# EasyEDA Pro project 蓝桥杯14届国赛.eprj, board PCB
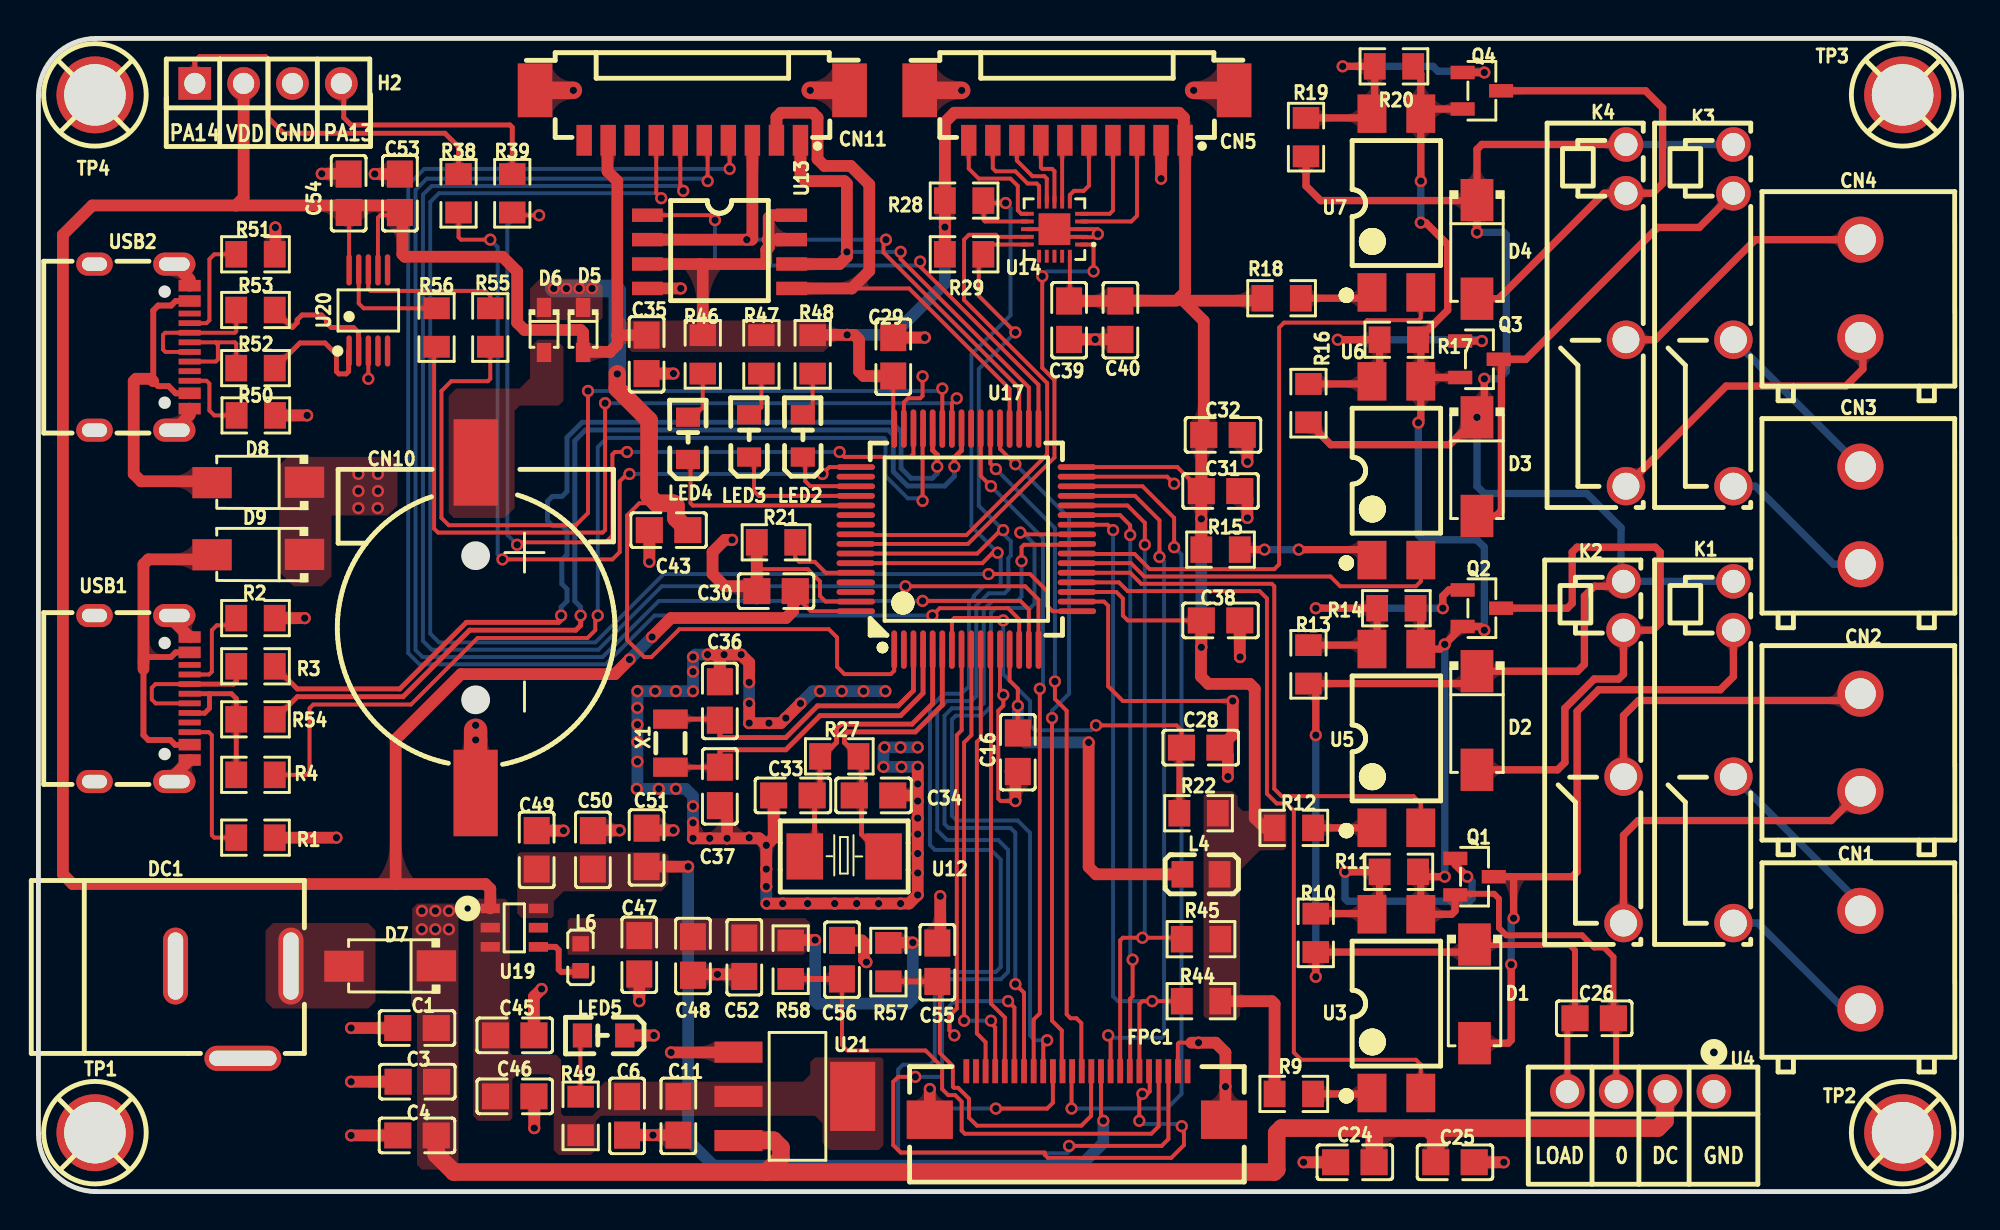
[diagram p3: board, top side]
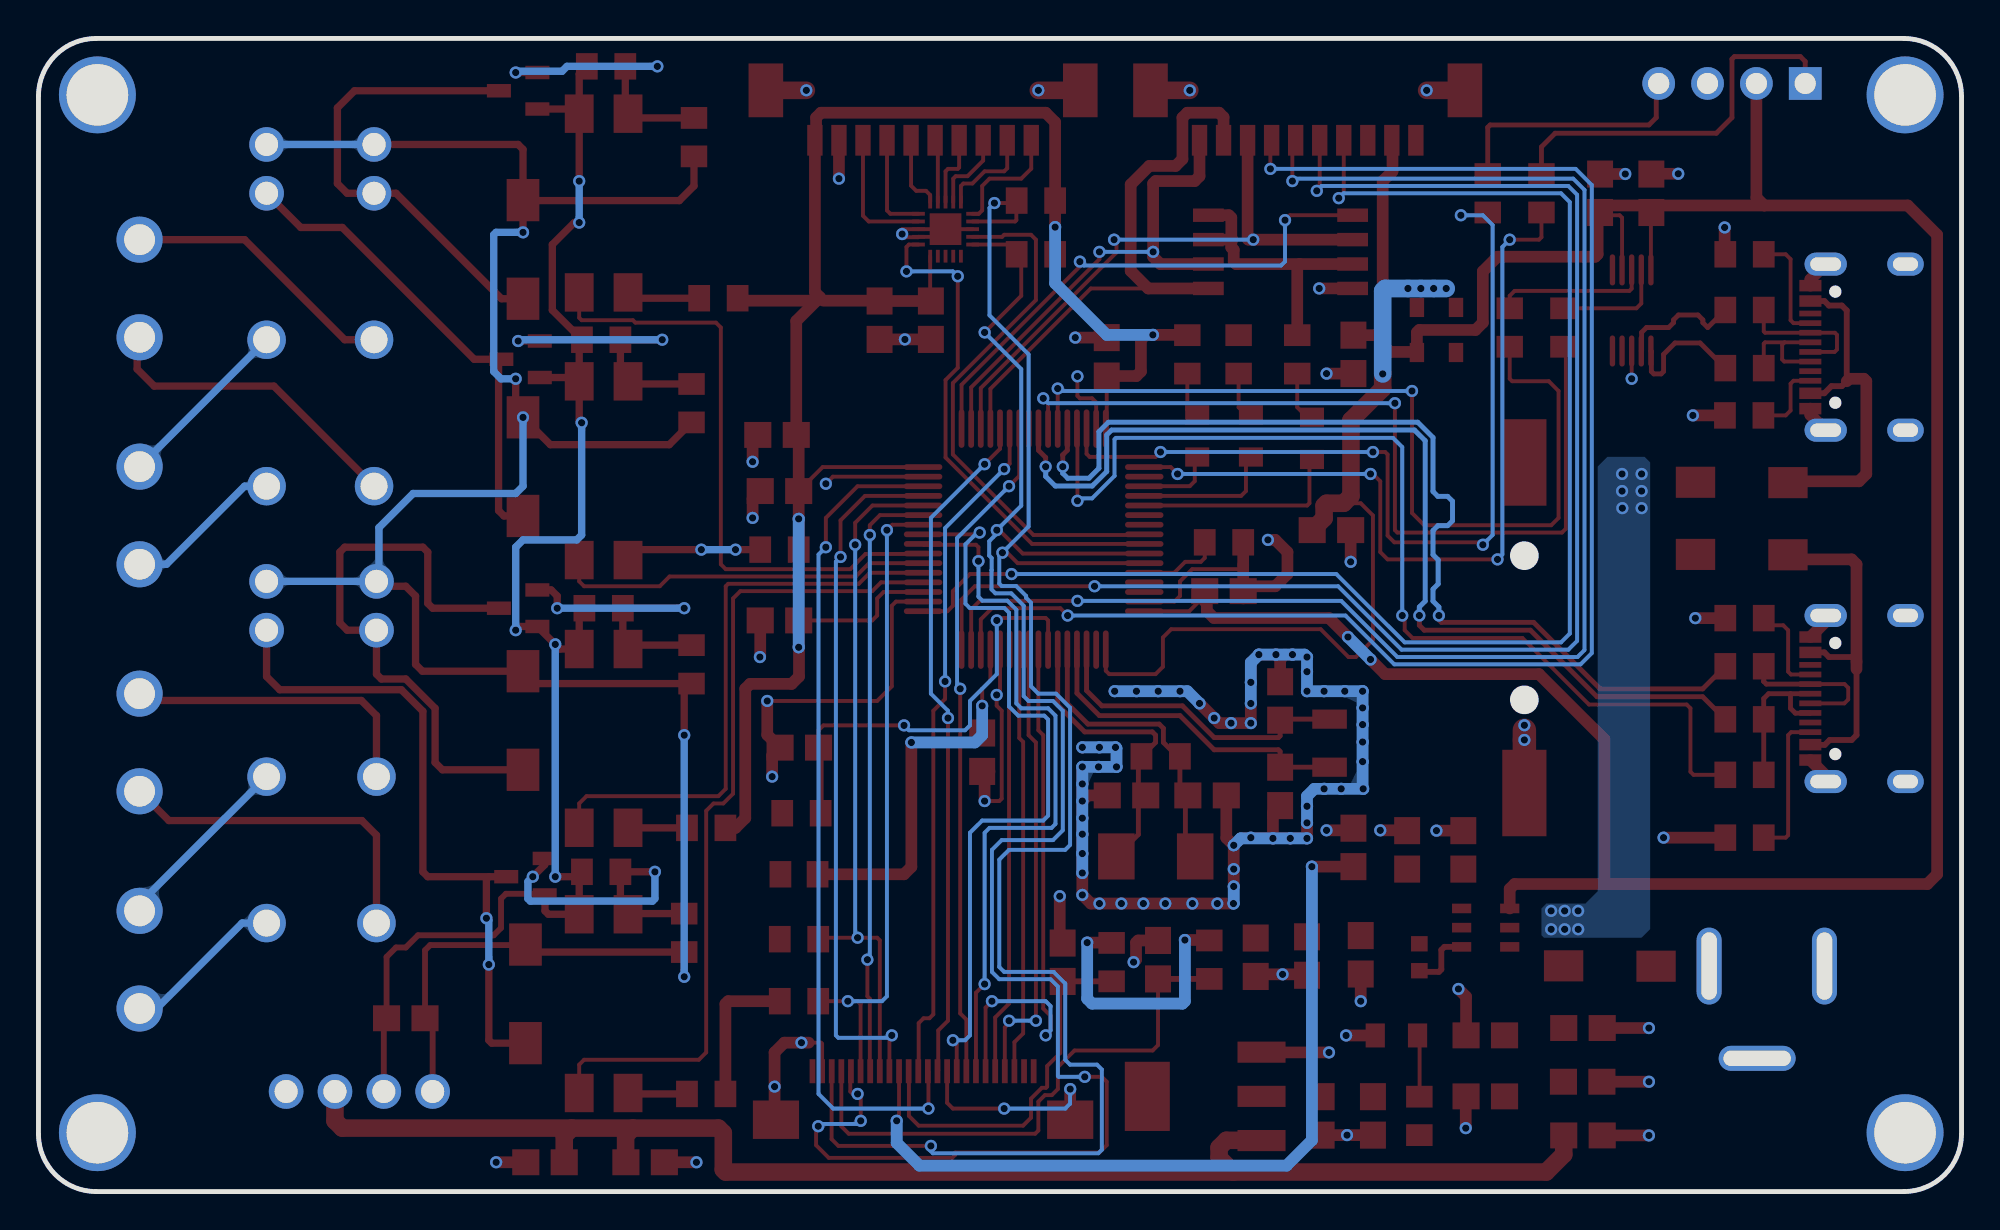
[diagram p4: board, bottom side, seen from below]

Outline 100 x 60 mm; copper layers: Top Layer, Bottom Layer. Coordinates in mm from the lower left corner of the outline.
Outline path: 0,57 arc(0.88,59.12) 3,60 97,60 arc(99.12,59.12) 100,57 100,3 arc(99.12,0.88) 97,0 3,0 arc(0.88,0.88) 0,3 0,57
Stack: Top Layer 0.035mm / Dielectric1 1.51mm FR4 er 4.5 / Bottom Layer 0.035mm

## Design rules (mm)
net USB_DN1: DP6
net $1N986: DP2
net $1N6306: DP2
net USB_DP2: DP3
net USB_DN2: DP3
net USB_CTRL: DP6
net M_HX1: DP5
net M_HX2: DP5
template: 自定义配置
spacing copperThickness1oz (default): track to track 0.178, other pairs 0.152 to 0.203
spacing copperThickness2oz: track to track 0.203, other pairs 0.152 to 0.3
track width copperThickness1oz (default): min 0.203, default 0.203, max 2.54
track width copperThickness2oz: min 0.203, default 0.254, max 2.54
track width PWR: min 0.203, default 0.61, max 2.54
differential pair differentialPair (default): width min 0.127, default 0.254, max 2.54; gap min 0.152, default 0.152
via viaSize (default): diameter min 0.635, default 0.635, max 10; hole min 0.381, default 0.381, max 6.299
net GND uses PWR
net VDD uses PWR
net +2V8 uses PWR
net +1V5 uses PWR
net VDDA uses PWR

## Placement (name value [footprint] x y rotation side)
C1  10uF  [C0805]  19.69 8.51 0 top
C3  10uF  [C0805]  19.7 5.72 0 top
C4  100nF  [C0805]  19.69 2.92 0 top
C6  100nF  [C0805]  30.61 3.94 90 top
C11  10uF  [C0805]  33.27 3.94 90 top
C16  0.1u  [C0805]  50.93 22.86 90 top
C24  4.7uF  [C0805]  68.45 1.52 0 top
C25  4.7uF  [C0805]  73.66 1.52 180 top
C26  10uF  [C0805]  80.9 9.02 0 top
C28  100nF  [C0805]  60.44 23.1 0 top
C29  100nF  [C0805]  44.45 43.43 90 top
C30  100nF  [C0805]  38.35 31.24 180 top
C31  100nF  [C0805]  61.47 36.45 0 top
C32  100nF  [C0805]  61.59 39.37 0 top
C33  20p  [C0805]  39.23 20.61 0 top
C34  20p  [C0805]  43.42 20.61 180 top
C35  100nF  [C0805]  31.62 43.56 90 top
C36  20p  [C0805]  35.43 25.53 270 top
C37  20p  [C0805]  35.43 21.08 90 top
C38  100nF  [C0805]  61.47 29.72 0 top
C39  10uF  [C0805]  53.59 45.34 270 top
C40  100nF  [C0805]  56.26 45.34 90 top
C43  100nF  [C0805]  32.77 34.42 180 top
C45  10uF  [C0805]  24.77 8.13 180 top
C46  10uF  [C0805]  24.77 4.95 180 top
C47  10uF  [C0805]  31.24 12.32 90 top
C48  10uF  [C0805]  34.03 12.26 90 top
C49  10uF  [C0805]  25.91 17.78 90 top
C50  10uF  [C0805]  28.83 17.78 90 top
C51  100nF  [C0805]  31.62 17.91 90 top
C52  100nF  [C0805]  36.7 12.19 90 top
C53  100nF  [C0805]  18.8 51.94 90 top
C54  100nF  [C0805]  16.13 51.94 270 top
C55  10u  [C0805]  46.74 11.93 270 top
C56  10u  [C0805]  41.78 12.06 90 top
CN1  KF128L-5.08-2P蓝色  [TH_KF128L-5.08-2P]  94.74 12.06 270 top
CN2  KF128L-5.08-2P蓝色  [TH_KF128L-5.08-2P]  94.74 23.37 270 top
CN3  KF128L-5.08-2P蓝色  [TH_KF128L-5.08-2P]  94.74 35.18 270 top
CN4  KF128L-5.08-2P蓝色  [TH_KF128L-5.08-2P]  94.74 46.99 270 top
CN5  KH-A1251WF-10A  [CONN_SMD_10P-P1.25_KINGHELM_KH-A1251WF-10A]  54 56 180 top
CN10  CR1220_B  [BAT-SMD_CR1220-2ZX]  22.73 29.34 270 top
CN11  KH-A1251WF-10A  [CONN_SMD_10P-P1.25_KINGHELM_KH-A1251WF-10A]  34 56 180 top
D1  SS14  [SMA_L4.2-W2.6-LS5.3-RD]  74.68 10.29 270 top
D2  SS14  [SMA_L4.2-W2.6-LS5.3-RD]  74.8 24.51 270 top
D3  SS14  [SMA_L4.2-W2.6-LS5.3-RD]  74.8 37.72 270 top
D4  SS14  [SMA_L4.2-W2.6-LS5.3-RD]  74.8 49.02 270 top
D5  1N4148WS  [SOD-323_L1.8-W1.3-LS2.5-RD]  28.32 44.83 270 top
D6  1N4148WS  [SOD-323_L1.8-W1.3-LS2.5-RD]  26.29 44.83 270 top
D7  SS34  [SMA_L4.3-W2.6-LS5.0-RD]  18.29 11.74 180 top
D8  SS34  [SMA_L4.3-W2.6-LS5.0-RD]  11.43 36.9 180 top
D9  SS34  [SMA_L4.3-W2.6-LS5.0-RD]  11.43 33.14 180 top
DC1  -  [DC-2.0]  10 12 180 top
FPC1  F-FPC0M24P-C310  [FPC-SMD_P0.50-24P_XJ-FGS]  54 5 180 top
H2  2.54-1*4P母  [HDR-TH_4P-P2.54-V-F]  11.94 57.66 0 top
K1  HF49FD/012-1H12  [RELAY-TH_HF49FD-XXX-1H12-XXX]  88.14 22.86 270 top
K2  HF49FD/012-1H12  [RELAY-TH_HF49FD-XXX-1H12-XXX]  82.42 22.86 270 top
K3  HF49FD/012-1H12  [RELAY-TH_HF49FD-XXX-1H12-XXX]  88.14 45.59 270 top
K4  HF49FD/012-1H12  [RELAY-TH_HF49FD-XXX-1H12-XXX]  82.55 45.59 270 top
L4  10uH  [L0805]  60.45 16.51 180 top
L6  BLM18AG601SN1D  [L0603]  28.19 12.19 90 top
LED2  -  [LED_0805]  39.75 39.37 90 top
LED3  -  [LED_0805]  36.96 39.37 90 top
LED4  -  [LED_0805]  33.78 39.24 90 top
LED5  -  [LED_0805]  29.34 8.13 180 top
Q1  SS8050  [SOT-23-3_L2.9-W1.3-P1.90-LS2.4-BR]  74.68 16.38 180 top
Q2  SS8050  [SOT-23-3_L2.9-W1.3-P1.90-LS2.4-BR]  75.06 30.35 180 top
Q3  SS8050  [SOT-23-3_L2.9-W1.3-P1.90-LS2.4-BR]  74.93 43.31 180 top
Q4  SS8050  [SOT-23-3_L2.9-W1.3-P1.90-LS2.4-BR]  75.06 57.28 180 top
R1  5.1K  [R0805]  11.28 18.42 0 top
R2  5.1K  [R0805]  11.28 29.84 0 top
R3  22R  [R0805]  11.28 27.33 0 top
R4  22R  [R0805]  11.28 21.68 0 top
R9  10kΩ  [R0805]  65.28 5.08 0 top
R10  10kΩ  [R0805]  66.42 13.46 270 top
R11  10kΩ  [R0805]  70.74 16.64 180 top
R12  10kΩ  [R0805]  65.28 18.92 0 top
R13  10kΩ  [R0805]  66.04 27.43 270 top
R14  10kΩ  [R0805]  70.61 30.35 180 top
R15  10kΩ  [R0805]  61.47 33.4 0 top
R16  10kΩ  [R0805]  66.04 41.02 270 top
R17  10kΩ  [R0805]  70.74 44.32 180 top
R18  10kΩ  [R0805]  64.64 46.48 0 top
R19  10kΩ  [R0805]  65.91 54.86 270 top
R20  10kΩ  [R0805]  70.49 58.55 180 top
R21  10K  [R0805]  38.35 33.78 0 top
R22  10K  [R0805]  60.32 19.69 0 top
R27  1M  [R0805]  41.65 22.64 0 top
R28  10kΩ  [R0805]  48.13 51.56 180 top
R29  10kΩ  [R0805]  48.13 48.77 0 top
R38  100R  [R0805]  21.84 51.94 270 top
R39  100R  [R0805]  24.64 51.94 270 top
R44  10K  [R0805]  60.45 9.91 0 top
R45  10K  [R0805]  60.45 13.13 0 top
R46  300R  [R0805]  34.54 43.56 270 top
R47  300R  [R0805]  37.59 43.56 270 top
R48  300R  [R0805]  40.26 43.56 270 top
R49  510R  [R0805]  28.19 3.94 270 top
R50  5.1K  [R0805]  11.3 40.39 0 top
R51  5.1K  [R0805]  11.28 48.77 0 top
R52  22R  [R0805]  11.28 42.84 0 top
R53  22R  [R0805]  11.28 45.87 0 top
R54  1.5K  [R0805]  11.28 24.57 0 top
R55  300R  [R0805]  23.5 44.96 270 top
R56  300R  [R0805]  20.7 44.96 270 top
R57  0R  [R0805]  44.2 11.94 90 top
R58  0R  [R0805]  39.12 12.06 90 top
TP1  -  [m3螺丝]  3 3 0 top
TP2  -  [m3螺丝]  97 3 0 top
TP3  -  [m3螺丝]  97 57 0 top
TP4  -  [m3螺丝]  3 57 0 top
U3  TLP521-1XSM  [SMD-4_L4.6-W6.5-P2.54-LS10.2-BL]  70.61 9.78 0 top
U4  B0505S-1WR3  [PWRM-TH_B0503S-1WR3]  83.31 5.21 180 top
U5  TLP521-1XSM  [SMD-4_L4.6-W6.5-P2.54-LS10.2-BL]  70.61 23.58 0 top
U6  TLP521-1XSM  [SMD-4_L4.6-W6.5-P2.54-LS10.2-BL]  70.61 37.51 0 top
U7  TLP521-1XSM  [SMD-4_L4.6-W6.5-P2.54-LS10.2-BL]  70.61 51.44 0 top
U12  8M-5032-2P  [CRYSTAL-SMD_L5.0-W3.2]  41.9 17.44 180 top
U13  GD25Q16CSAG-SOP8_208MIL  [SOP-8_L5.2-W5.3-P1.27-LS7.9-BL]  35.41 48.9 270 top
U14  MDC04  [QFN-20_L3.0-W3.0-P0.40-BL-EP1.7]  52.83 50.08 90 top
U17  GD32F103RCT6  [LQFP-64_L10.0-W10.0-P0.50-LS12.0-BL]  48.25 33.95 0 top
U19  -  [SOT_DPV]  23.5 14.73 0 top
U20  CH340E  [MSOP-10_L3.0-W3.0-P0.50-LS5.0-BL]  17.15 45.85 0 top
U21  AMS1117-3.3  [SOT-223-3_L6.5-W3.4-P2.30-LS7.0-BR]  39.37 4.95 180 top
USB1  CQ-USB-TYPE-C16P母座四脚插板有柱  [USB-C-SMD_CQ-USB-TYPE-C]  5.39 25.65 270 top
USB2  CQ-USB-TYPE-C16P母座四脚插板有柱  [USB-C-SMD_CQ-USB-TYPE-C]  5.39 43.94 270 top
X1  32.768kHz  [FC-135R_L3.2-W1.5]  32.86 23.33 90 top

## Footprints (pads in the part's own frame, mm; a bottom-side part is the same pattern mirrored in y, then rotated)
BAT-SMD_CR1220-2ZX
  rect 4.5x2.3 smd: 1(-8.6,0) 2(8.6,0)
C0805
  rect 1.41x1.35 smd: 1(-1,0) 2(1,0)
CONN_SMD_10P-P1.25_KINGHELM_KH-A1251WF-10A
  rect 0.8x1.6 smd: 1(-5.625,1.3) 2(-4.375,1.3) 3(-3.125,1.3) 4(-1.875,1.3) 5(-0.625,1.3) 6(0.625,1.3) 7(1.875,1.3) 8(3.124,1.3) 9(4.375,1.3) 10(5.625,1.3)
  rect 1.8x2.8 smd: 11(8.175,-1.3) 12(-8.175,-1.3)
CRYSTAL-SMD_L5.0-W3.2
  rect 1.9x2.4 smd: 1(-2.05,0) 2(2.05,0)
DC-2.0
  oval 4x1.3 hole 3.5x0.8: 2(-0.627,5.067)
  oval 1.3x4 hole 0.8x3.5: 3(2.873,0.267) 4(-3.127,0.267)
FC-135R_L3.2-W1.5
  rect 1x1.8 smd: 1(-1.25,0) 2(1.25,0)
FPC-SMD_P0.50-24P_XJ-FGS
  rect 0.3x1.25 smd: 1(-5.752,-1.262) 2(-5.25,-1.262) 3(-4.75,-1.262) 4(-4.25,-1.262) 5(-3.75,-1.262) 6(-3.25,-1.262) 7(-2.75,-1.262) 8(-2.25,-1.262) 9(-1.75,-1.262) 10(-1.25,-1.262) 11(-0.75,-1.262) 12(-0.25,-1.262) 13(0.25,-1.262) 14(0.75,-1.262) 15(1.25,-1.262) 16(1.75,-1.262) 17(2.25,-1.262) 18(2.75,-1.262) 19(3.25,-1.262) 20(3.75,-1.262) 21(4.25,-1.262) 22(4.75,-1.262) 23(5.25,-1.262) 24(5.75,-1.262)
  rect 2.4x2 smd: 25(-7.65,1.262) 26(7.65,1.262)
HDR-TH_4P-P2.54-V-F
  rect 1.7x1.7 hole 1.1: 1(-3.81,0)
  round 1.7 hole 1.1: 2(-1.27,0) 3(1.27,0) 4(3.81,0)
L0603
  rect 0.8x0.864 smd: 1(-0.7,0) 2(0.7,0)
L0805
  rect 1.133x1.377 smd: 1(-0.966,0) 2(0.966,0)
LED_0805
  rect 1x1.25 smd: 1(-1.15,0.005) 2(1.05,0.005)
LQFP-64_L10.0-W10.0-P0.50-LS12.0-BL
  oval 0.3x2 smd: 1(-3.75,-5.75) 2(-3.25,-5.75) 3(-2.75,-5.75) 4(-2.25,-5.75) 5(-1.75,-5.75) 6(-1.25,-5.75) 7(-0.75,-5.75) 8(-0.25,-5.75) 9(0.25,-5.75) 10(0.75,-5.75) 11(1.25,-5.75) 12(1.75,-5.75) 13(2.25,-5.75) 14(2.75,-5.75) 15(3.25,-5.75) 16(3.75,-5.75) 33(3.75,5.75) 34(3.25,5.75) 35(2.75,5.75) 36(2.25,5.75) 37(1.75,5.75) 38(1.25,5.75) 39(0.75,5.75) 40(0.25,5.75) 41(-0.25,5.75) 42(-0.75,5.75) 43(-1.25,5.75) 44(-1.75,5.75) 45(-2.25,5.75) 46(-2.75,5.75) 47(-3.25,5.75) 48(-3.75,5.75)
  oval 2x0.3 smd: 17(5.75,-3.75) 18(5.75,-3.25) 19(5.75,-2.75) 20(5.75,-2.25) 21(5.75,-1.75) 22(5.75,-1.25) 23(5.75,-0.75) 24(5.75,-0.25) 25(5.75,0.25) 26(5.75,0.75) 27(5.75,1.25) 28(5.75,1.75) 29(5.75,2.25) 30(5.75,2.75) 31(5.75,3.25) 32(5.75,3.75) 49(-5.75,3.75) 50(-5.75,3.25) 51(-5.75,2.75) 52(-5.75,2.25) 53(-5.75,1.75) 54(-5.75,1.25) 55(-5.75,0.75) 56(-5.75,0.25) 57(-5.75,-0.25) 58(-5.75,-0.75) 59(-5.75,-1.25) 60(-5.75,-1.75) 61(-5.75,-2.25) 62(-5.75,-2.75) 63(-5.75,-3.25) 64(-5.75,-3.75)
m3螺丝
  round 4 hole 3.2: 1(-0.064,0.064)
MSOP-10_L3.0-W3.0-P0.50-LS5.0-BL
  oval 0.28x1.62 smd: 1(-1,-2.11) 2(-0.5,-2.11) 3(0,-2.11) 4(0.5,-2.11) 5(1,-2.11) 6(1,2.11) 7(0.5,2.11) 8(0,2.11) 9(-0.5,2.11) 10(-1,2.11)
PWRM-TH_B0503S-1WR3
  round 1.8 hole 1.2: 1(-3.81,0) 2(-1.27,0) 3(1.27,0) 4(3.81,0)
QFN-20_L3.0-W3.0-P0.40-BL-EP1.7
  rect 0.2x0.665 smd: 1(-0.8,-1.407) 2(-0.4,-1.407) 3(0,-1.407) 4(0.4,-1.407) 5(0.8,-1.407) 11(0.8,1.407) 12(0.4,1.407) 13(0,1.407) 14(-0.4,1.407) 15(-0.8,1.407)
  rect 0.665x0.2 smd: 6(1.407,-0.8) 7(1.407,-0.4) 8(1.407,0) 9(1.407,0.4) 10(1.407,0.8) 16(-1.407,0.8) 17(-1.407,0.4) 18(-1.407,0) 19(-1.407,-0.4) 20(-1.407,-0.8)
  rect 1.65x1.65 smd: 21(0,0)
R0805
  rect 1.133x1.377 smd: 1(-1,0) 2(1,0)
RELAY-TH_HF49FD-XXX-1H12-XXX
  round 1.8 hole 1.2: 1(-8.89,0) 2(-6.35,0)
  round 2 hole 1.4: 3(1.27,0) 4(8.89,0)
SMA_L4.2-W2.6-LS5.3-RD
  rect 2.2x1.7 smd: 1(-2.566,0) 2(2.566,0)
SMA_L4.3-W2.6-LS5.0-RD
  rect 2.046x1.62 smd: 1(-2.404,-0.009) 2(2.404,0.009)
SMD-4_L4.6-W6.5-P2.54-LS10.2-BL
  rect 1.5x2 smd: 1(-1.27,-4.65) 2(1.27,-4.65) 3(1.27,4.65) 4(-1.27,4.65)
SOD-323_L1.8-W1.3-LS2.5-RD
  rect 1x0.75 smd: 1(-1.173,0) 2(1.173,0)
SOP-8_L5.2-W5.3-P1.27-LS7.9-BL
  rect 0.7x1.6 smd: 1(-1.905,-3.75) 2(-0.635,-3.75) 3(0.635,-3.75) 4(1.905,-3.75) 5(1.905,3.75) 6(0.635,3.75) 7(-0.635,3.75) 8(-1.905,3.75)
SOT-23-3_L2.9-W1.3-P1.90-LS2.4-BR
  rect 1.25x0.7 smd: 1(1,-0.95) 2(1,0.95) 3(-1,0)
SOT-223-3_L6.5-W3.4-P2.30-LS7.0-BR
  rect 2.5x1.1 smd: 1(2.97,-2.3) 2(2.97,0) 3(2.97,2.3)
  rect 2.34x3.6 smd: 4(-2.97,0)
SOT_DPV
  rect 1x0.5 smd: 1(0,0) 2(0,-1) 3(0,-2) 4(2.5,-2) 5(2.5,-1) 6(2.5,0)
TH_KF128L-5.08-2P
  round 2.4 hole 1.6: 1(-2.54,0) 2(2.54,0)
USB-C-SMD_CQ-USB-TYPE-C
  oval 1.2x2.2 hole 0.7x1.6: 0(-4.32,1.675) 0(4.32,1.675)
  oval 1.2x1.9 hole 0.7x1.3: 0(-4.32,-2.475) 0(4.32,-2.475)
  rect 0.6x1.15 smd: A1B12(-3.2,2.471) A4B9(-2.4,2.471) B1A12(3.2,2.475) B4A9(2.4,2.475)
  rect 0.3x1.15 smd: A5(-1.25,2.475) A6(-0.25,2.475) A7(0.25,2.474) A8(1.25,2.475) B5(1.75,2.475) B6(0.75,2.475) B7(-0.75,2.473) B8(-1.75,2.475)

## Nets
As in the schematic.

Pads without a net: CN11 8; FPC1 1 23 24; U14 16 17 18 19; U17 2 40 50 54 55 61 62; U20 4 5 6; USB1 A8 B8; USB2 A8 B8

## Via types
v1: diameter 0.635, hole 0.381, Top Layer to Bottom Layer, 227 vias

## Routing (per net, layer and track width the routed paths; a pad name or vN(x,y) marks a point on that pad's centre or on a via; arc(x,y) is an arc through that point)
+1V5: length 42.8
  Top Layer w0.203: FPC1.10 55.25,3.81 v1(55.37,3.68)
  Top Layer w0.61: C51.1 v1(33.78,16.91)
  Bottom Layer w0.61: v1(33.78,16.91) 33.78,2.67 35.1,1.35 54.19,1.35 55.37,2.53 v1(55.37,3.68)
+2V8: length 14
  Top Layer w0.61: 44.32,12.94 44.34,12.95 v1(45.47,12.95) ; 38.92,13.09 v1(40.39,13.09)
  Bottom Layer w0.61: v1(45.47,12.95) 45.47,10.03 45.21,9.78 40.51,9.78 40.39,9.91 v1(40.39,13.09)
GND: length 231.8
  Top Layer w0.203: 59.95,7.75 59.31,7.75 59.25,7.69 FPC1.2 ; 54,37.2 58.69,37.2 v1(59.06,36.83) ; v1(62.1,25.53) 56.39,25.53 55.63,26.29 55.63,30.48 55.41,30.7 U17.18 ; U14.13 U14.21 ; U14.21 53.23,49.68 U14.2 54.26,49.66 54.92,49.66 v1(55.09,49.82) 55.09,50.07 55.08,50.08 U14.3 U14.21 ; U17.63 40.93,30.7 40.64,30.99 40.64,31.75 40,32.39 37.57,32.39 37.35,32.6 ; U17.12 50,25.91 50.07,25.84 v1(50.17,25.84) 50.17,25.28 49.91,25.02 49.91,20.45 50.04,20.32 v1(50.8,20.32) ; FPC1.15 52.75,4.62 52.45,4.32 v1(49.78,4.32) ; 45,39.7 45,41.06 45.21,41.28 45.85,41.28 45.97,41.4 v1(45.97,42.42) ; U20.3 v1(17.15,42.29)
  Top Layer w0.61: 35.18,27.94 35.43,27.69 C36.1 ; 35.18,27.94 v1(34.79,27.94) ; 35.18,27.94 v1(35.65,27.94) v1(36.54,27.94) 36.96,27.52 v1(36.96,26.5) ; v1(35.81,18.38) v1(34.91,18.38) v1(34.04,18.38) v1(34.04,19.19) ; v1(35.81,18.38) 37.48,18.38 v1(37.85,18.02) ; v1(35.81,18.38) 35.81,19.71 C37.1 ; LED5.1 v1(32,8.12) ; v1(37.85,18.02) v1(37.85,16.78) v1(37.85,15.88) ; v1(37.85,18.02) 38.23,18.4 C33.1 ; v1(62.87,35.05) 62.87,36.05 C31.2 ; USB2.0 7.86,47.46 USB2.A1B12 ; USB1.0 7.06,21.65 USB1.B1A12 ; C46.1 25.78,4.94 v1(25.78,3.3) ; v1(62.1,25.53) 62.1,23.77 C28.2 61.85,22.68 v1(61.85,21.59) ; C50.2 28.84,18.8 v1(30.23,18.8) ; C24.1 v1(65.79,1.52) ; C1.1 v1(16.26,8.51) ; v1(62.87,37.97) 62.87,39.1 C32.2 ; v1(43.05,11.94) 42.93,12.06 42.93,12.95 42.81,13.06 C56.2 ; 37.35,33.4 37.35,31.5 ; 59.95,7.75 v1(60.32,7.75) 61.21,7.75 61.72,7.24 v1(61.72,5.46) 61.72,3.81 FPC1.25 ; v1(26.16,10.54) 25.77,10.14 C45.1 ; USB1.A1B12 7.06,29.65 USB1.0 ; C53.2 18.79,52.95 v1(17.49,52.95) ; v1(45.72,20.32) v1(45.72,19.43) v1(45.72,18.6) v1(45.72,17.59) v1(45.72,16.58) v1(45.72,15.44) 45.27,14.99 v1(44.83,14.99) v1(43.69,14.99) v1(42.54,14.99) v1(41.4,14.99) v1(40,14.99) v1(38.7,14.99) v1(37.86,14.99) ; v1(45.72,20.32) v1(45.72,21.21) v1(45.72,22.1) ; v1(45.72,20.32) 45.43,20.61 C34.1 ; C39.2 v1(54.94,44.34) 56.13,44.34 ; 37.35,30.86 C30.2 37.35,31.5 ; v1(31.24,9.91) 31.24,11.32 ; R50.2 v1(13.97,40.39) ; v1(33.02,18.8) 31.73,18.8 C51.2 ; C4.1 v1(16.26,2.92) ; C49.2 v1(27.31,18.78) ; v1(36.96,25.4) v1(36.96,24.38) v1(37.98,24.38) 38.6,24.38 v1(38.86,24.64) v1(39.62,25.4) ; v1(46.89,15.37) 46.89,12.95 46.87,12.93 ; C54.1 16.11,52.96 v1(14.73,52.96) ; C43.2 v1(31.77,32.77) ; USB2.B1A12 7.86,40.42 USB2.0 ; C38.2 62.47,27.83 v1(62.48,27.81) ; C11.1 v1(31.95,2.94) C6.1 ; C25.1 v1(76.2,1.52) ; C52.1 36.59,11.3 v1(35.31,11.3) 34.08,11.3 C48.1 ; 37.35,31.5 35.69,31.5 35.05,32.13 35.05,33.27 35.69,33.91 v1(36.07,33.91) ; v1(50.8,20.32) 50.8,21.86 50.78,21.84 50.56,21.84 50.55,21.86 ; U13.4 v1(33.4,46.99) ; 46.1,44.45 v1(46.09,44.43) C29.2 ; v1(32.89,7.24) 36.39,7.24 U21.1 ; v1(12.32,50.17) 12.32,48.8 R51.2 ; C3.1 v1(16.26,5.72) ; R2.2 v1(13.84,29.84) ; FPC1.26 v1(46.35,5.33) ; v1(15.49,18.42) R1.2 ; CN5.2 v1(58.38,52.7) ; C35.1 v1(33.02,42.56)
  Top Layer w0.914: CN11.12 v1(40.13,57.3) ; CN11.11 v1(27.81,57.3) ; CN5.11 v1(48.01,57.3) ; CN5.12 v1(60.07,57.3)